# EasyEDA Pro project Designs.eprj, board PCB50_1
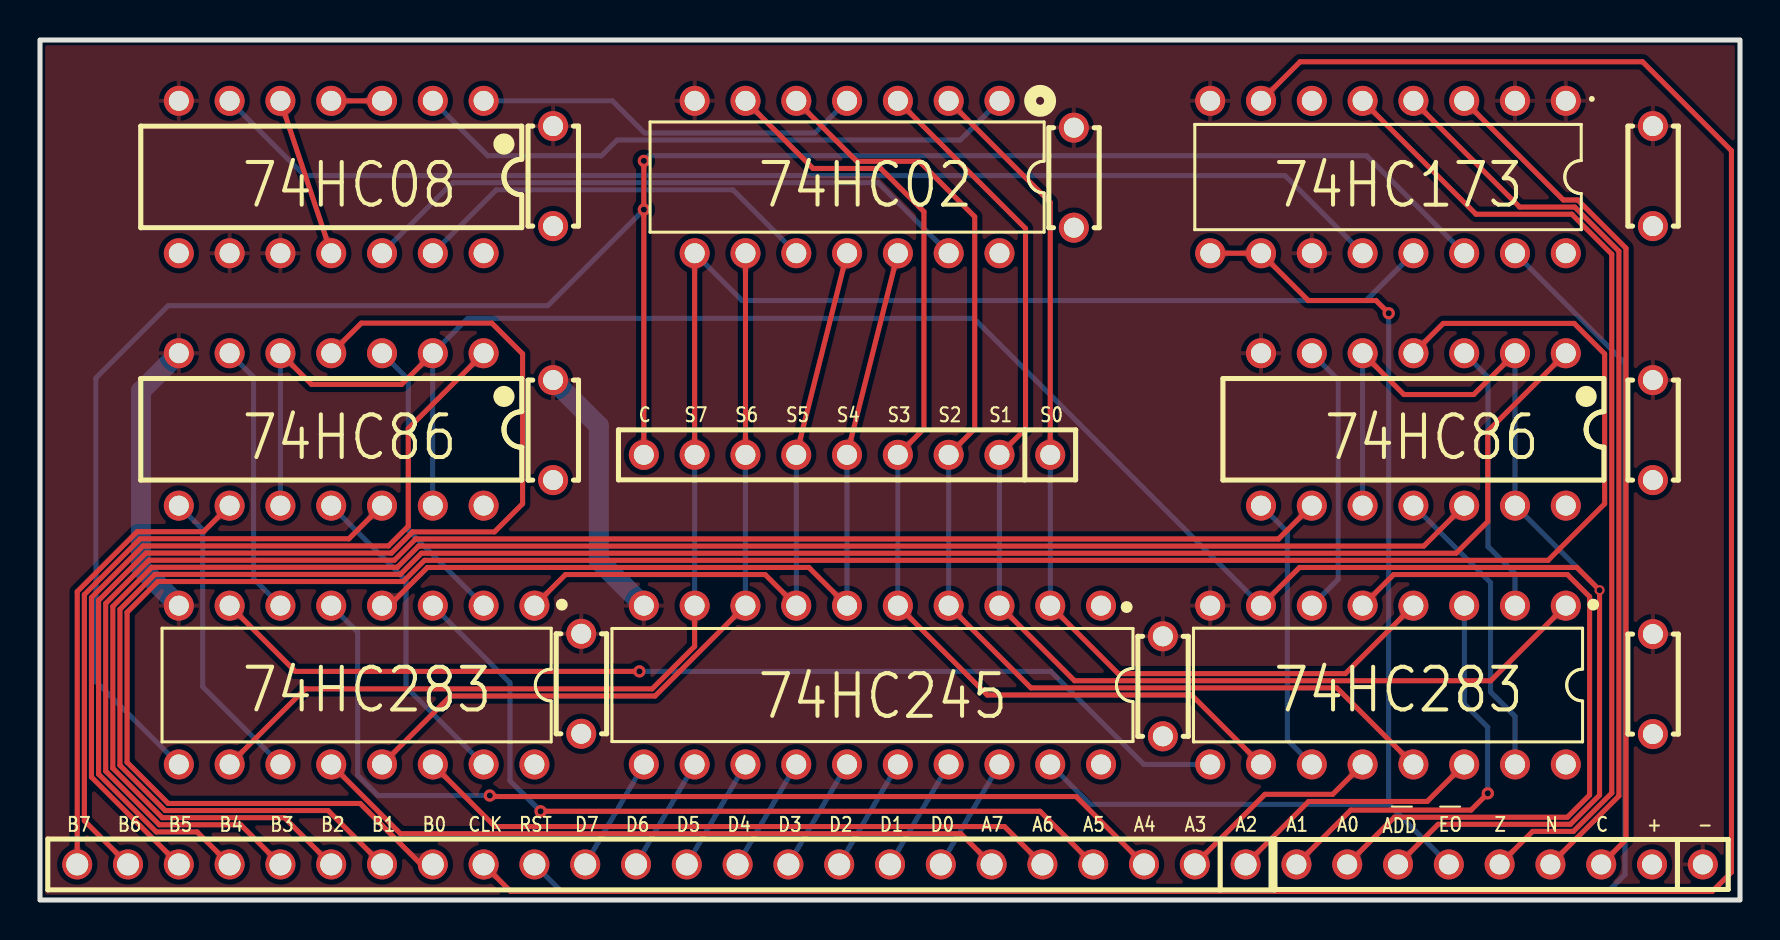
[diagram p13: board, top side]
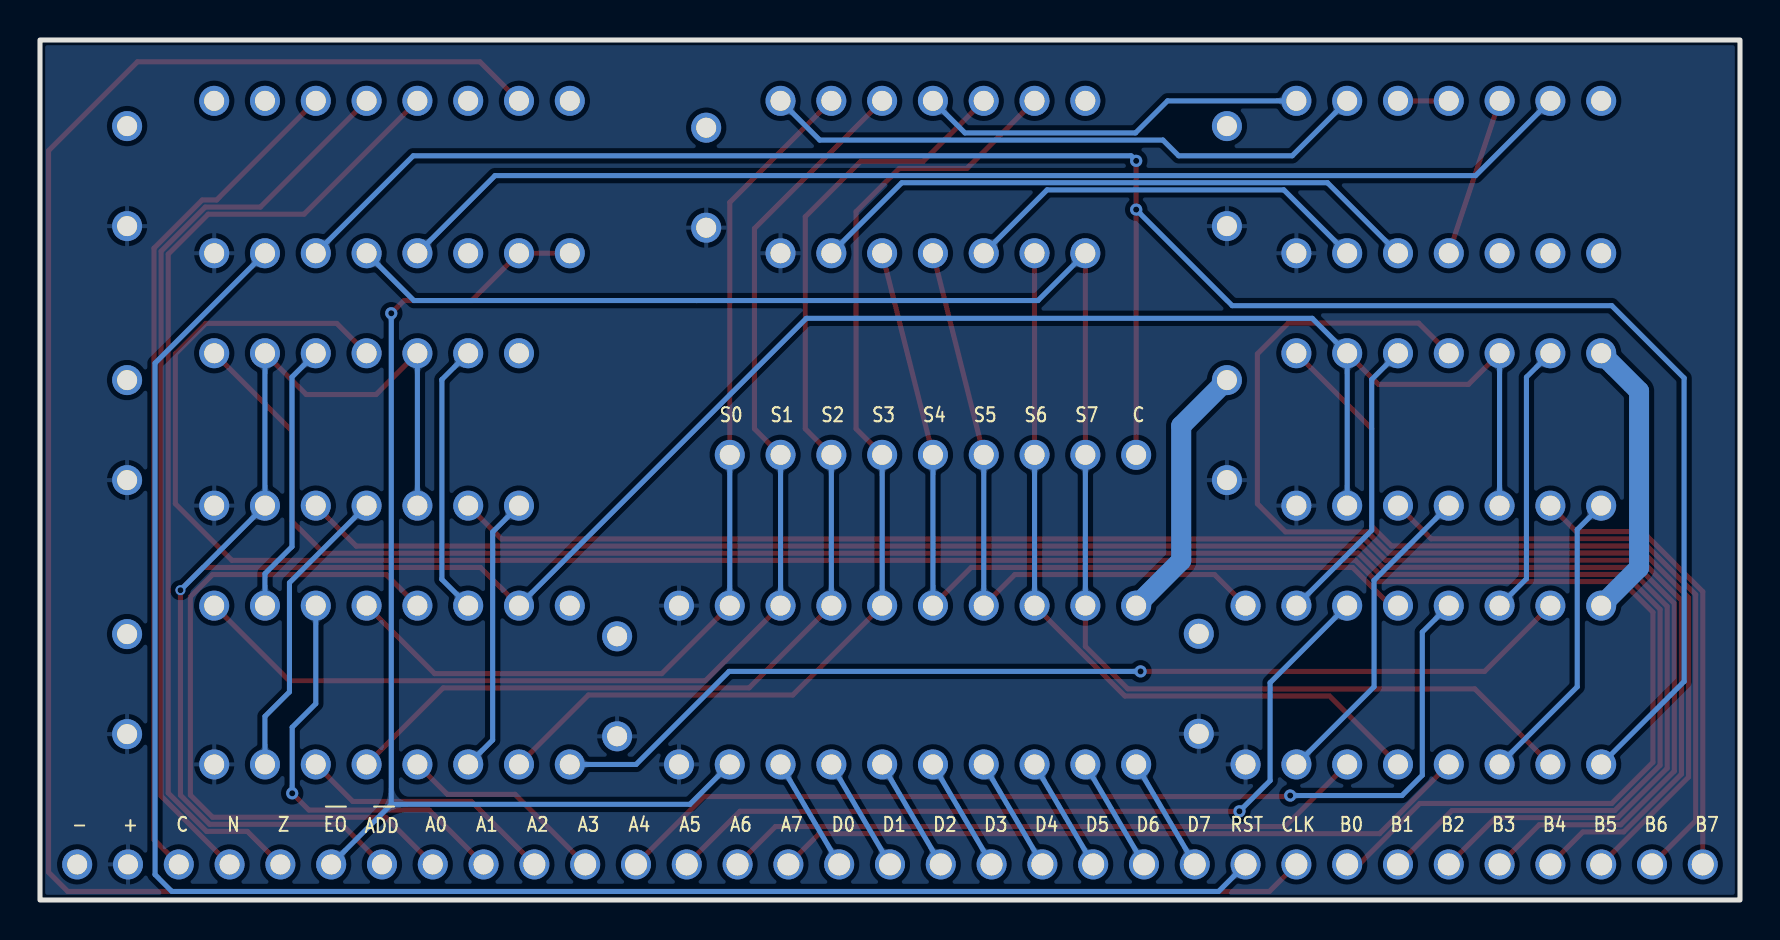
[diagram p14: board, bottom side, seen from below]

Outline 85 x 43 mm; copper layers: Top Layer, Bottom Layer. Coordinates in mm from the lower left corner of the outline.
Outline path: rectangle 0,43 85,0
Stack: Top Layer 0.035mm / Dielectric1 1.51mm FR4 er 4.5 / Bottom Layer 0.035mm

## Design rules (mm)
template: JLCPCB Capability(Two Layers Board)
spacing copperThickness1oz (default): track to track 0.102, other pairs 0.152 to 0.3
spacing copperThickness2oz: track to track 0.203, other pairs 0.152 to 0.3
track width copperThickness1oz (default): min 0.127, default 0.254, max 2.54
track width copperThickness2oz: min 0.203, default 0.254, max 2.54
differential pair differentialPair (default): width min 0.127, default 0.254, max 2.54; gap min 0.152, default 0.152
via viaSize (default): diameter min 0.5, default 0.61, max 10; hole min 0.3, default 0.305, max 6.3

## Placement (name value [footprint] x y rotation side)
C61  100nF  [CAP-TH_L5.0-W2.5-P5.00-D1.0]  80.65 10.8 90 top
C62  100nF  [CAP-TH_L5.0-W2.5-P5.00-D1.0]  25.65 36.19 90 top
C63  100nF  [CAP-TH_L5.0-W2.5-P5.00-D1.0]  25.65 23.5 90 top
C64  100nF  [CAP-TH_L5.0-W2.5-P5.00-D1.0]  51.69 36.11 90 top
C65  100nF  [CAP-TH_L5.0-W2.5-P5.00-D1.0]  80.65 23.5 90 top
C66  100nF  [CAP-TH_L5.0-W2.5-P5.00-D1.0]  56.14 10.68 90 top
C67  100nF  [CAP-TH_L5.0-W2.5-P5.00-D1.0]  27.06 10.81 90 top
C68  100nF  [CAP-TH_L5.0-W2.5-P5.00-D1.0]  80.65 36.19 90 top
U9  CD74HC173E  [PDIP-16_L19.2-W6.6-P2.54-LS7.6-BL]  67.4 36.15 180 top
U69  74HC283P-E  [PDIP-16_L19.3-W6.4-P2.54-LS7.94-BL]  67.4 10.75 180 top
U70  SN74HC86N(LX)  [PDIP-14_L19.3-W6.5-P2.54-LS7.6-BL]  14.56 23.53 180 top
U237  SN74HC245N3  [PDIP-20_L25.9-W6.6-P2.54-LS7.9-BL]  41.62 10.75 180 top
U315  74HC02N  [DIP-14_L19.6-W6.4-P2.54-LS7.6-BL]  40.35 36.15 180 top
U316  SN74HC08NE4  [PDIP-14_L19.3-W6.5-P2.54-LS7.6-BL]  14.56 36.15 180 top
U317  74HC283P-E  [PDIP-16_L19.3-W6.4-P2.54-LS7.94-BL]  15.83 10.75 180 top
U318  SN74HC86N(LX)  [PDIP-14_L19.3-W6.5-P2.54-LS7.6-BL]  68.67 23.53 180 top
U384  TH2.54-24P排针(母)(邮寄专用)  [HDR-TH_24P-P2.54-V-F]  31.07 1.78 180 top
U388  HDR2.54-LI-9P  [HDR-TH_9P-P2.54-V-M]  40.35 22.26 180 top
U390  HDR2.54-LI-9P  [HDR-TH_9P-P2.54-V-M]  72.98 1.78 180 top

## Footprints (pads in the part's own frame, mm; a bottom-side part is the same pattern mirrored in y, then rotated)
CAP-TH_L5.0-W2.5-P5.00-D1.0
  round 1.5 hole 1: 1(-2.5,0) 2(2.5,0)
DIP-14_L19.6-W6.4-P2.54-LS7.6-BL
  round 1.5 hole 1: 1(-7.62,-3.81) 2(-5.08,-3.81) 3(-2.54,-3.81) 4(0,-3.81) 5(2.54,-3.81) 6(5.08,-3.81) 7(7.62,-3.81) 8(7.62,3.81) 9(5.08,3.81) 10(2.54,3.81) 11(0,3.81) 12(-2.54,3.81) 13(-5.08,3.81) 14(-7.62,3.81)
HDR-TH_9P-P2.54-V-M
  round 1.5 hole 1: 1(-10.16,0) 2(-7.62,0) 3(-5.08,0) 4(-2.54,0) 5(0,0) 6(2.54,0) 7(5.08,0) 8(7.62,0) 9(10.16,0)
HDR-TH_24P-P2.54-V-F
  round 1.5 hole 1.1x1: 1(-29.21,0) 2(-26.67,0) 3(-24.13,0) 4(-21.59,0) 5(-19.05,0) 6(-16.51,0) 7(-13.97,0) 8(-11.43,0) 9(-8.89,0) 10(-6.35,0) 11(-3.81,0) 12(-1.27,0) 13(1.27,0) 14(3.81,0) 15(6.35,0) 16(8.89,0) 17(11.43,0) 18(13.97,0) 19(16.51,0) 20(19.05,0) 21(21.59,0) 22(24.13,0) 23(26.67,0) 24(29.21,0)
PDIP-14_L19.3-W6.5-P2.54-LS7.6-BL
  round 1.5 hole 1: 1(-7.62,-3.81) 2(-5.08,-3.81) 3(-2.54,-3.81) 4(0,-3.81) 5(2.54,-3.81) 6(5.08,-3.81) 7(7.62,-3.81) 8(7.62,3.81) 9(5.08,3.81) 10(2.54,3.81) 11(0,3.81) 12(-2.54,3.81) 13(-5.08,3.81) 14(-7.62,3.81)
PDIP-16_L19.2-W6.6-P2.54-LS7.6-BL
  round 1.5 hole 1: 1(-8.89,-3.81) 2(-6.35,-3.81) 3(-3.81,-3.81) 4(-1.27,-3.81) 5(1.27,-3.81) 6(3.81,-3.81) 7(6.35,-3.81) 8(8.89,-3.81) 9(8.89,3.81) 10(6.35,3.81) 11(3.81,3.81) 12(1.27,3.81) 13(-1.27,3.81) 14(-3.81,3.81) 15(-6.35,3.81) 16(-8.89,3.81)
PDIP-16_L19.3-W6.4-P2.54-LS7.94-BL
  round 1.5 hole 1: 1(-8.89,-3.97) 2(-6.35,-3.97) 3(-3.81,-3.97) 4(-1.27,-3.97) 5(1.27,-3.97) 6(3.81,-3.97) 7(6.35,-3.97) 8(8.89,-3.97) 9(8.89,3.97) 10(6.35,3.97) 11(3.81,3.97) 12(1.27,3.97) 13(-1.27,3.97) 14(-3.81,3.97) 15(-6.35,3.97) 16(-8.89,3.97)
PDIP-20_L25.9-W6.6-P2.54-LS7.9-BL
  round 1.5 hole 1: 1(-11.43,-3.97) 2(-8.89,-3.97) 3(-6.35,-3.97) 4(-3.81,-3.97) 5(-1.27,-3.97) 6(1.27,-3.97) 7(3.81,-3.97) 8(6.35,-3.97) 9(8.89,-3.97) 10(11.43,-3.97) 11(11.43,3.97) 12(8.89,3.97) 13(6.35,3.97) 14(3.81,3.97) 15(1.27,3.97) 16(-1.27,3.97) 17(-3.81,3.97) 18(-6.35,3.97) 19(-8.89,3.97) 20(-11.43,3.97)

## Nets
As in the schematic.

Pads without a net: U9 6; U316 8

## Via types
v1: diameter 0.61, hole 0.305, Top Layer to Bottom Layer, 7 vias
v2: diameter 0.5, hole 0.3, Top Layer to Bottom Layer, 1 via

## Routing (per net, layer and track width the routed paths; a pad name or vN(x,y) marks a point on that pad's centre or on a via; arc(x,y) is an arc through that point)
GND: length 27.3
  Bottom Layer w1: C63.2 27.94,23.71 27.94,16.97 U237.10 ; U317.8 5.05,16.61 5.05,25.44 U70.7
A0: length 35.9
  Top Layer w0.254: U69.5 67.68,16.27 76.37,16.27 77.48,15.16 77.48,5.25 76.37,4.14 67.72,4.14 U390.8
A1: length 20.9
  Top Layer w0.254: U390.9 65.54,4.5 71.55,4.5 v1(72.39,5.33)
  Bottom Layer w0.254: v1(72.39,5.33) 72.39,8.64 71.21,9.82 U69.3
A2: length 13
  Top Layer w0.254: U69.14 69.36,4.93 63.43,4.93 U384.1
A3: length 10.5
  Top Layer w0.254: U69.12 64.64,5.28 61.25,5.28 U384.2
A4: length 50.2
  Top Layer w0.254: U384.3 51.81,5.17 22.54,5.17 v1(22.49,5.22)
  Bottom Layer w0.254: v1(22.49,5.22) 16.9,5.22 15.89,6.24 15.89,13.39 U317.5
A5: length 41.2
  Top Layer w0.254: U384.4 50,4.44 v1(25.03,4.44)
  Bottom Layer w0.254: v1(25.03,4.44) 23.5,5.97 23.5,10.86 U317.3
A6: length 32.6
  Top Layer w0.254: U384.5 48.22,3.67 22.75,3.67 U317.14
A7: length 35.1
  Top Layer w0.254: U384.6 46.04,3.32 18.02,3.32 U317.12
ADD: length 142.7
  Top Layer w0.254: U318.2 71.69,25.27 68.2,25.27 U318.5 ; 77.98,15.49 76.84,16.63 62.98,16.63 U69.7 ; U70.5 13.58,25.78 18.08,25.78 19.64,27.34 ; v2(77.98,15.49) 77.98,5.24 76.52,3.78 69.91,3.78 U390.7
  Bottom Layer w0.254: U318.5 U318.10 ; U318.2 U318.13 v2(77.98,15.49) ; 19.64,19.72 19.64,27.34 21.39,29.08 46.69,29.08 U69.7 ; U70.5 U70.10
B0: length 119.3
  Top Layer w0.254: U384.17 19.06,1.78 16.01,4.83 6.41,4.83 4.35,6.88 4.35,14.39 5.89,15.92 18.16,15.92 19.22,16.98 75.4,16.98 78.23,19.81 78.23,27.31 76.71,28.83 70.16,28.83 U318.4
B1: length 103.2
  Top Layer w0.254: U384.18 14.41,4.47 6.26,4.47 4,6.74 4,14.53 5.74,16.28 18.01,16.28 19.08,17.34 70.81,17.34 72.39,18.92 72.39,23.44 U318.1
B2: length 90.7
  Top Layer w0.254: U384.19 12.22,4.12 6.11,4.12 3.64,6.59 3.64,14.68 5.59,16.64 17.87,16.64 18.93,17.7 69.19,17.7 U318.12
B3: length 81.4
  Top Layer w0.254: U318.9 61.92,18.05 18.78,18.05 17.72,16.99 5.45,16.99 3.28,14.83 3.28,6.44 5.97,3.76 10.04,3.76 U384.20
B4: length 58.6
  Top Layer w0.254: U384.21 7.86,3.4 5.82,3.4 2.93,6.29 2.93,14.98 5.3,17.35 17.57,17.35 18.63,18.41 22.73,18.41 24.13,19.81 24.13,27.31 22.59,28.84 16.07,28.84 U70.4
B5: length 42.7
  Top Layer w0.254: U384.22 2.57,6.15 2.57,15.12 5.15,17.7 17.42,17.7 18.41,18.69 18.41,23.57 U70.1
B6: length 31.1
  Top Layer w0.254: 17.1,19.72 15.44,18.06 5.01,18.06 2.22,15.27 2.22,3.96 U384.23
B7: length 23
  Top Layer w0.254: 9.48,19.72 8.18,18.42 4.86,18.42 1.86,15.42 U384.24
C-FLAG: length 109.8
  Top Layer w0.254: U388.9 v1(30.19,34.52) v1(30.19,36.96)
  Bottom Layer w0.254: v1(30.19,34.52) 25.39,29.72 6.41,29.72 2.79,26.1 2.79,10.92 U317.9 ; U9.14 66.34,37.21 30.45,37.21 v1(30.19,36.96)
C-FLAG-OUT: length 42.5
  Top Layer w0.254: U390.3 79.3,3.02 79.3,32.59 76.88,35 76.17,35 U9.3
CLK: length 125.6
  Top Layer w0.254: U384.16 23.53,0.43 83.61,0.43 84.57,1.39 84.57,37.47 80.13,41.91 63,41.91 U9.7
DATA0: length 5.8
  Bottom Layer w0.254: U237.18 U384.7
DATA1: length 5.8
  Bottom Layer w0.254: U384.8 U237.17
DATA2: length 5.8
  Bottom Layer w0.254: U237.16 U384.9
DATA3: length 5.8
  Bottom Layer w0.254: U384.10 U237.15
DATA4: length 5.8
  Bottom Layer w0.254: U237.14 U384.11
DATA5: length 5.8
  Bottom Layer w0.254: U384.12 U237.13
DATA6: length 5.8
  Bottom Layer w0.254: U237.12 U384.13
DATA7: length 5.8
  Bottom Layer w0.254: U384.14 U237.11
EO: length 56.7
  Top Layer w0.254: v1(67.44,29.34) 66.8,29.97 63.42,29.97 U9.10 U9.9
  Bottom Layer w0.254: U390.6 67.44,4.78 ; 67.44,4.78 v1(67.44,29.34) ; 67.44,4.78 52.51,4.78 U237.19
N-FLAG-OUT: length 45.5
  Top Layer w0.254: U9.4 73.98,34.65 76.74,34.65 78.94,32.44 78.94,5.2 U390.4
RST: length 88.8
  Bottom Layer w0.254: U9.15 79.25,26.84 79.25,1.27 78.41,0.43 26.07,0.43 U384.15
S0: length 48.3
  Top Layer w0.254: U315.2 50.51,34.88 U388.1 ; U237.2 53.91,11.32 65.27,11.32 U69.4
  Bottom Layer w0.254: U388.1 U237.2
S1: length 59.9
  Top Layer w0.254: U69.1 72.53,10.96 51.73,10.96 U237.3 ; U315.3 49.28,33.58 49.28,23.56 U388.2
  Bottom Layer w0.254: U237.3 U388.2
S2: length 57.8
  Top Layer w0.254: U315.5 40.84,36.93 43.97,36.93 46.74,34.16 46.74,23.56 U388.3 ; U237.4 49.54,10.61 64.84,10.61 U69.13
  Bottom Layer w0.254: U388.3 U237.4
S3: length 52.9
  Top Layer w0.254: U237.5 47.36,10.25 57.58,10.25 U69.10 ; U388.4 44.2,23.56 44.2,34.42 42.04,36.58 38.66,36.58 U315.6
  Bottom Layer w0.254: U237.5 U388.4
S4: length 42.8
  Top Layer w0.254: U237.6 38.44,16.63 19.37,16.63 17.46,14.72 U317.4 ; U388.5 U315.12
  Bottom Layer w0.254: U388.5 U237.6
S5: length 32.3
  Top Layer w0.254: U317.1 26.28,16.27 36.26,16.27 U237.7 ; U315.11 U388.6
  Bottom Layer w0.254: U237.7 U388.6
S6: length 39.1
  Top Layer w0.254: U317.13 20.52,10.2 30.75,10.2 U237.8 ; U388.7 35.27,22.26 U315.9
  Bottom Layer w0.254: U388.7 U237.8
S7: length 83.2
  Top Layer w0.254: U388.8 32.73,32.34 U315.8 ; U237.9 32.73,12.68 30.61,10.56 13.26,10.56 9.48,6.78
  Bottom Layer w0.254: U9.13 66.3,29.97 35.1,29.97 U315.8 ; U237.9 U388.8
Z-FLAG: length 59.8
  Bottom Layer w0.254: U9.12 62.25,36.22 13.22,36.22 9.48,39.96
Z-FLAG-OUT: length 49.7
  Top Layer w0.254: U390.5 74.63,3.43 76.67,3.43 78.59,5.35 78.59,32.29 76.59,34.29 71.8,34.29 U9.5
$1N764: length 13.7
  Bottom Layer w0.254: U318.3 72.4,26.15 72.4,17.67 73.75,16.32 U69.2
$1N772: length 13.7
  Bottom Layer w0.254: U69.6 64.91,16.03 64.91,26.02 U318.6
$1N777: length 14
  Bottom Layer w0.254: U69.11 62.37,8 62.37,18.4 U318.8
$1N783: length 15
  Bottom Layer w0.254: U69.15 73.75,9.18 72.53,10.4 72.53,15.86 U318.11
$1N810: length 15
  Bottom Layer w0.254: U317.11 8.14,10.66 8.14,18.52 U70.8
$1N816: length 16.1
  Bottom Layer w0.254: U70.11 18.3,15.98 18.3,10.66 U317.15
$1N3688: length 2.5
  Top Layer w0.254: 17.1,39.96 U316.4
$1N3689: length 8
  Top Layer w0.254: U316.5 U316.11
$1N3887: length 13.7
  Bottom Layer w0.254: U317.6 10.68,16.06 10.68,26.14 9.48,27.34
$1N3892: length 14.7
  Bottom Layer w0.254: 17.1,27.34 18.41,26.02 18.41,18.48 U317.2
$1N6309: length 52.3
  Top Layer w0.254: v1(29.97,11.43) 12.77,11.43 9.48,14.72
  Bottom Layer w0.254: U69.9 55.2,6.78 50.55,11.43 v1(29.97,11.43)
$1N9251: length 19.5
  Bottom Layer w0.254: U316.1 28.62,39.96 30.23,38.35 38.75,38.35 U315.4
$1N9257: length 30.6
  Bottom Layer w0.254: U315.1 46.01,38 28.85,38 28.07,37.21 22.39,37.21 19.64,39.96
$1N9267: length 31.3
  Bottom Layer w0.254: 17.1,32.34 20.63,35.86 41.91,35.86 U315.13
$1N9273: length 20.8
  Bottom Layer w0.254: 19.64,32.34 22.81,35.51 34.64,35.51 U315.10

## Copper pours and planes (outline as drawn; the poured copper is in the pictures)
GND on Top Layer: 0,43 84.78,43 84.78,0 0,0
VCC on Bottom Layer: 0,43 85,43 85,0 0,0

Small or netless copper shapes (teardrops, artwork), in the pictures only: 92 on Top Layer, 93 on Bottom Layer

## Text on the board
Bottom Silkscreen Layer: | | B7 | B6 | B5 | B4 | B3 | B2 | B1 | B0 | CLK | RST | D7 | D6 | C | D5 | S7 | D4 | S6 | D3 | S5 | D2 | S4 | D1 | S3 | D0 | S2 | A7 | S1 | A6 | S0 | A5 | A4 | A3 | A2 | A1 | A0 | ADD | EO | Z | N | + | -
Top Silkscreen Layer: B7 | B6 | B5 | B4 | B3 | B2 | B1 | B0 | CLK | RST | D7 | D6 | C | D5 | S7 | D4 | S6 | D3 | S5 | D2 | S4 | D1 | S3 | D0 | S2 | A7 | S1 | A6 | S0 | A5 | A4 | A3 | A2 | A1 | A0 | ADD | EO | Z | N | + | - | | | 74HC08 | 74HC86 | 74HC283 | 74HC245 | 74HC02 | 74HC173
